# EasyEDA Pro project BlueberryPi.eprj, board PCB1 (continued)
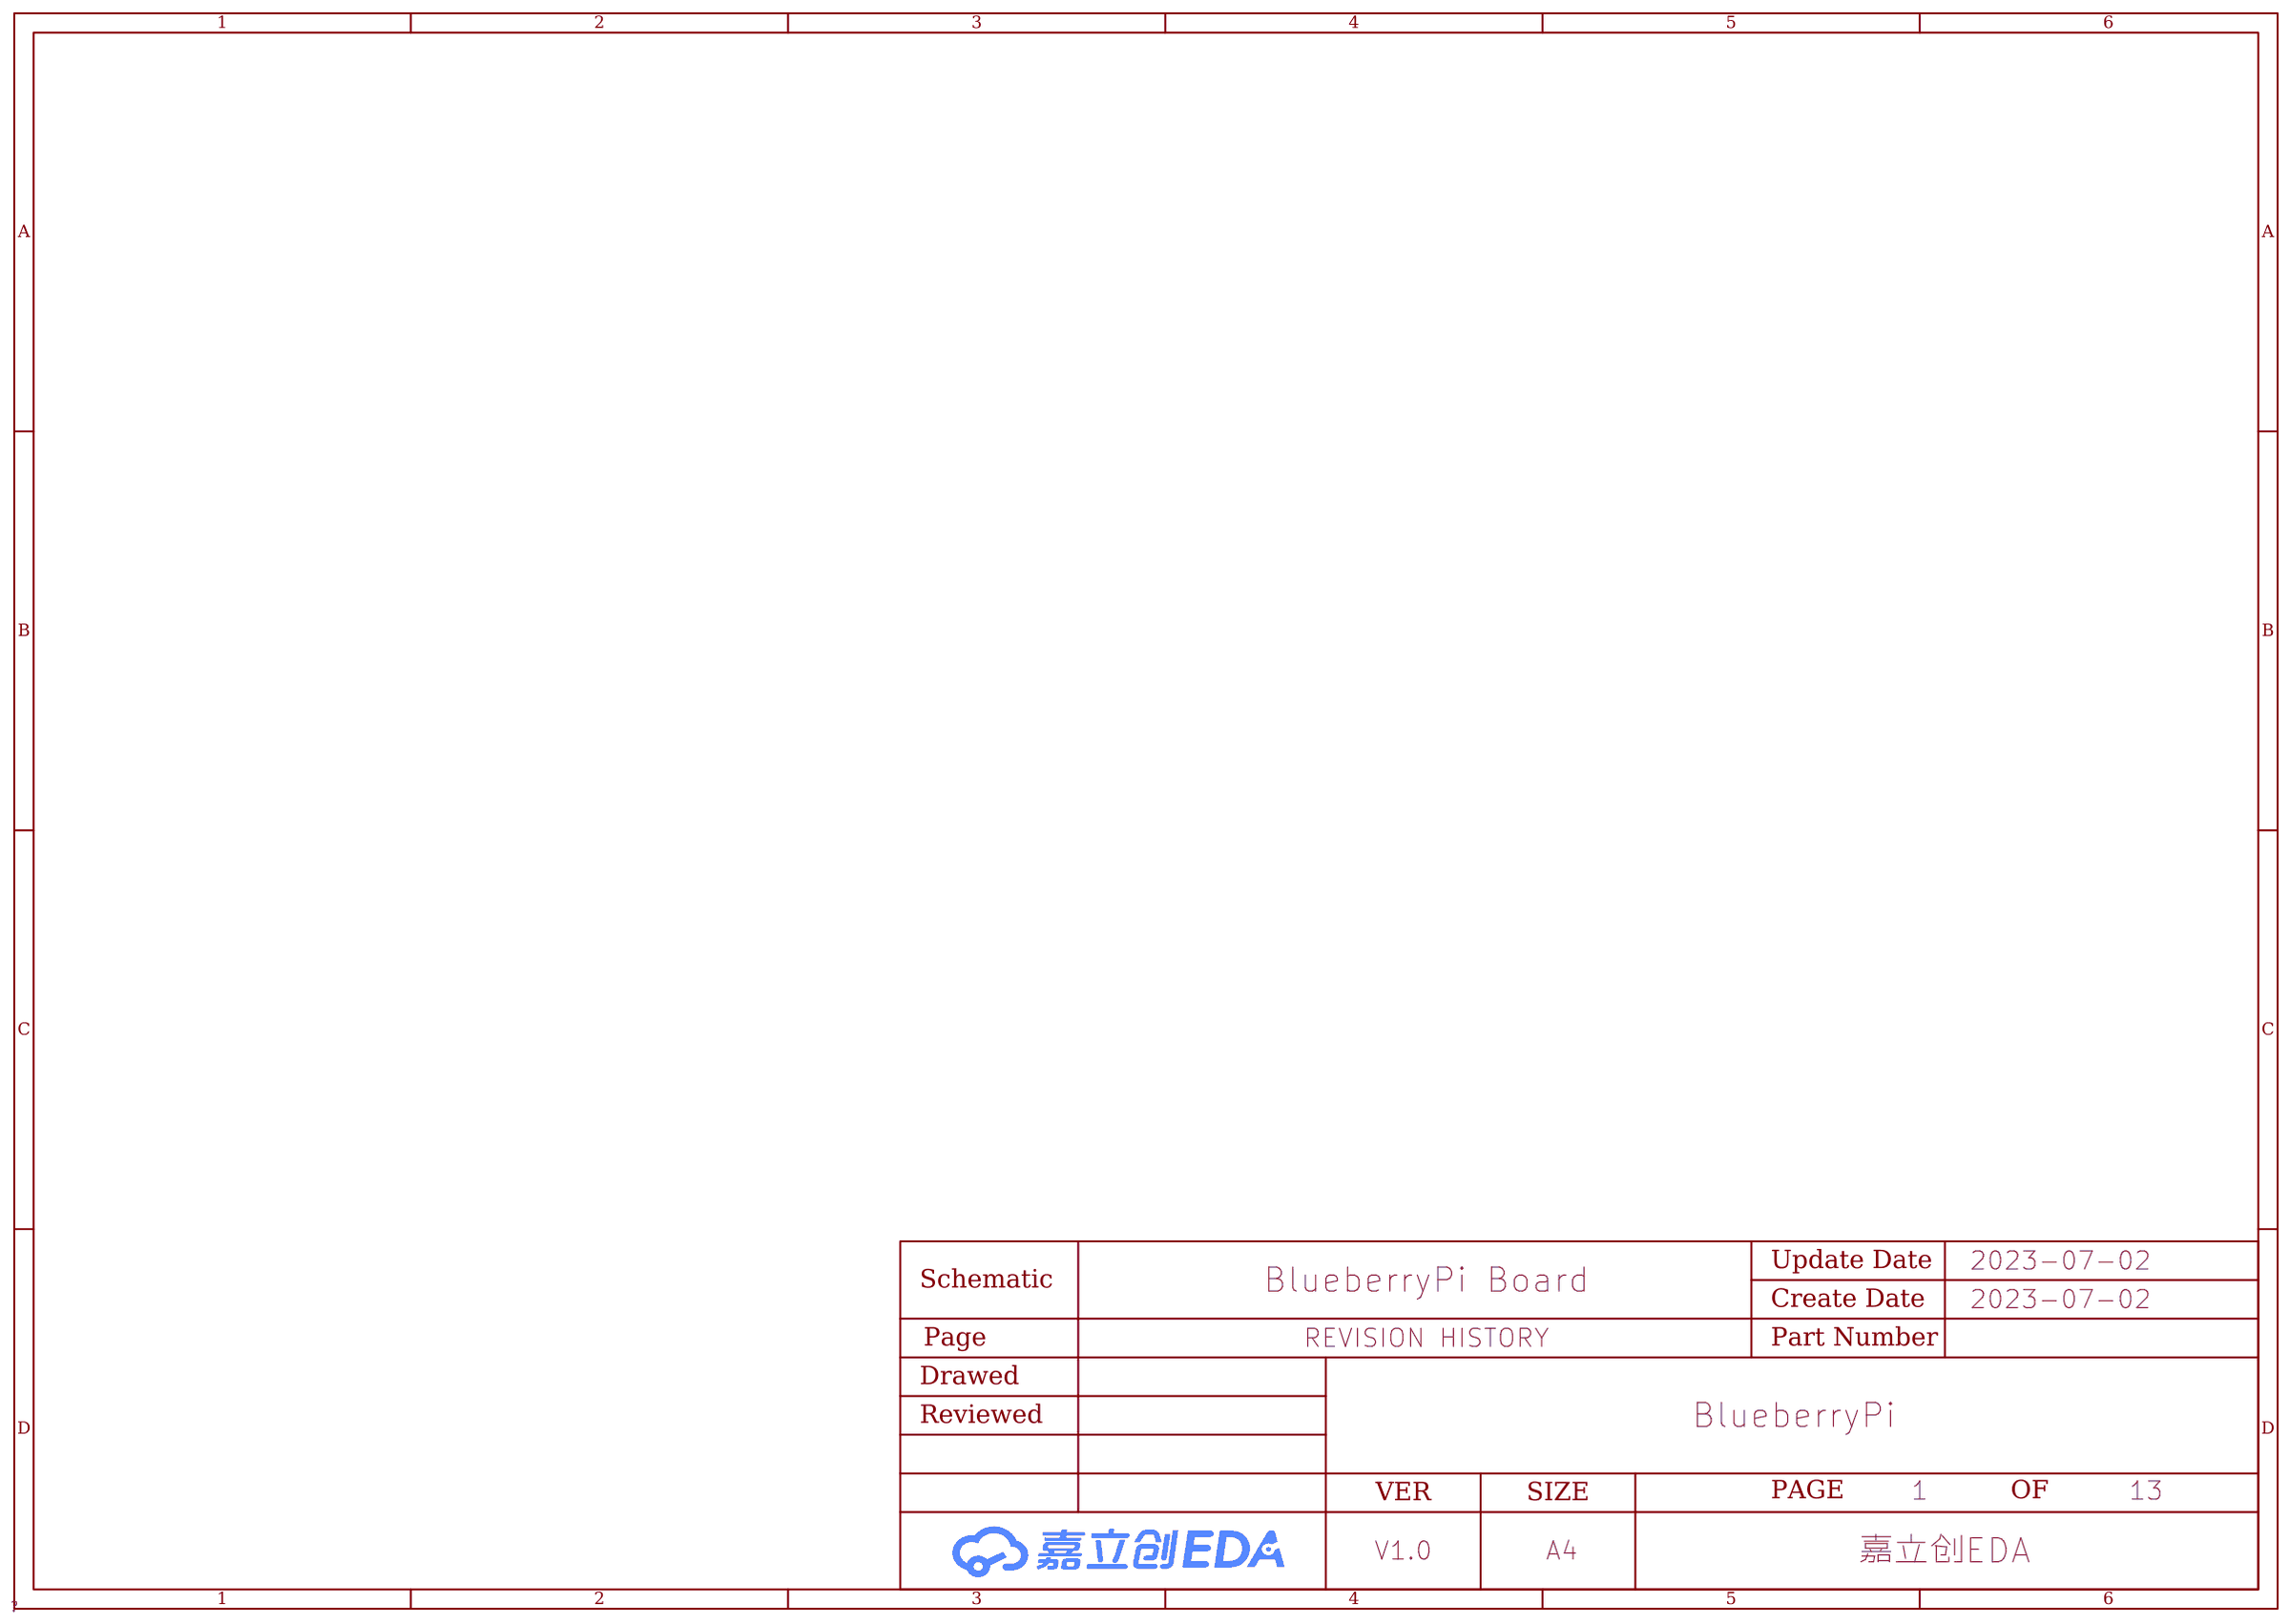
[diagram p0: REVISION HISTORY]
## Routing (per net, layer and track width the routed paths; a pad name or vN(x,y) marks a point on that pad's centre or on a via; arc(x,y) is an arc through that point) (continued)
VCC-PC: length 157.2
  Top Layer w0.203: U39.C6 69.37,49.28 v2(69.37,49.81) ; v2(74.37,48.28) v2(73.87,47.78) v2(74.37,47.28)
  Top Layer w0.254: v2(13.72,41.28) 13.22,40.78 8.63,40.78 R33.1 ; U39.M4 v2(73.87,47.78) ; v2(69.37,50.33) v2(69.37,49.81)
  04PWR w0.254: v2(74.37,48.28) v2(73.87,47.78) ; v2(73.87,47.78) 73.15,47.78 72.89,48.04 72.89,48.53 72.63,48.78 71.78,48.78 71.44,49.12 71.44,49.49 71.12,49.81 v2(69.37,49.81) v2(69.37,50.33) 68.9,50.8 67.03,50.8 65.11,48.88 v2(54.08,48.88) ; v2(73.87,47.78) v2(74.37,47.28)
  Bottom Layer w0.254: v2(28.29,54.99) 27.55,55.73 26.48,55.73 25.73,54.98 25.73,53.29 v2(13.72,41.28) 15.65,39.34 15.65,39.29 17.49,37.45 21.2,37.45 24.37,34.28 24.37,22.8 29.71,17.46 55.05,17.46 74.59,37 R42.1 74.59,47.06 v2(74.37,47.28) 74.37,47.78 ; C1.2 56.13,48.88 v2(54.08,48.88) ; v2(69.37,49.81) v2(69.37,50.33) ; v2(74.37,48.28) 74.37,47.78 ; 74.37,47.78 74.37,47.78 v2(73.87,47.78)
VDD18-LPDDR: length 75.8
  Top Layer w0.254: U35.A3 U35.A4 U35.A5 U35.A6 v2(40.69,27.14) ; v2(58.2,27.14) U35.U6 U35.U5 U35.U4 U35.U3 ; U35.U10 54.74,30.35 v2(54.74,30.45) ; v2(44.07,30.45) 44.22,30.45 U35.A10
  Top Layer w0.305: R26.2 31.99,48.11 v2(31.99,37.53) v2(31.99,36.97)
  03SIG w0.254: v2(31.99,36.97) v2(31.99,37.53) ; 40.69,27.71 40.69,31.21 36.8,35.09 33.54,35.09 31.99,36.64 ; 40.69,27.71 43.43,30.45 v2(44.07,30.45) ; 40.69,27.71 v2(40.69,27.14) 45.59,22.24 53.31,22.24 v2(58.2,27.14) 58.2,27.56 55.31,30.45 v2(54.74,30.45)
  03SIG w0.305: 31.99,36.64 v2(31.99,36.97)
VDD-CPU: length 14.2
  Top Layer w0.203: L2.2 9.35,66.41 C112.2
  Top Layer w0.254: L1.2 3.49,62.86 C110.2
  Top Layer w0.305: v2(52.13,48.23) v2(52.78,48.23) v2(52.78,48.88) ; v2(52.13,48.23) U1.P15 ; v2(52.13,48.23) v2(52.13,48.88) ; v2(52.78,49.53) v2(52.13,49.53) ; v2(52.78,49.53) v2(52.78,48.88) ; v2(52.78,49.53) v2(52.78,50.18) v2(52.13,50.18) v2(52.13,49.53) ; v2(52.13,49.53) v2(52.13,48.88) ; v2(52.78,48.88) v2(52.13,48.88)
  vias: v2(5.77,66.06) v2(5.77,65.3) v2(5.77,64.53) v2(6.53,66.06) v2(6.53,65.3) v2(6.53,64.53) v2(7.29,66.06) v2(7.29,65.3) v2(7.29,64.53) v2(34.04,59.16) v2(35.56,59.16)
VDD-CPUFB: length 109.1
  Top Layer w0.305: v2(52.78,46.93) U1.R16
  04PWR w0.254: v2(29.48,66.66) 30.38,66.66 35.58,61.47 42.22,61.47 42.58,61.82 70.5,61.82 75.93,56.39 75.93,47.04 72.34,43.45 67.06,43.45 63.14,47.36 53.21,47.36 v2(52.78,46.93)
  Bottom Layer w0.254: v2(29.48,66.66) 15.8,66.66 12.88,63.74 v2(12.88,60.66) v2(12.88,60.16)
VDD-CPUS: length 10.3
  04PWR w0.254: v2(59.7,53.8) 59.64,53.86 54.51,53.86 v2(54.08,53.43)
  Bottom Layer w0.254: C10.2 58.86,53.9 C12.2 ; v2(54.08,53.43) 53.77,53.12 53.77,52.53 54.2,52.1 54.2,51.6 v2(53.43,50.83)
VDD-GPU: length 8.3
  Top Layer w0.203: 5.79,53.24 2.78,53.24 2.69,53.33
  Top Layer w0.305: v2(46.93,50.18) v2(46.93,49.53) ; v2(46.93,49.53) v2(47.58,49.53) v2(47.58,48.88) ; v2(46.93,49.53) v2(46.93,48.88) ; v2(46.93,48.88) v2(46.93,48.23) v2(47.58,48.23) v2(47.58,48.88) ; v2(46.93,48.88) v2(47.58,48.88)
  vias: v2(5.26,53.47) v2(5.26,52.7) v2(6.02,53.47) v2(6.02,52.7) v2(6.78,53.47) v2(6.78,52.7) v2(32.91,50.57) v2(34.39,50.27)
VDD-GPUFB: length 66.2
  Top Layer w0.203: U37.47 v2(9.63,58)
  03SIG w0.254: v2(9.63,58) 8.7,57.07 8.7,51.7 4.01,47.02 4.01,43.31 7.61,39.71 v2(28.41,39.71)
  Bottom Layer w0.254: v2(28.41,39.71) 35.33,39.71 44.03,48.41 45.45,48.41 v2(46.28,47.58)
VDD-SYS: length 21.9
  Top Layer w0.203: U37.9 15.08,52.51 15.9,51.69 L4.2 15.9,46.9 C116.2
  Top Layer w0.305: v2(50.83,52.13) v2(50.18,52.13) ; v2(50.83,52.13) v2(50.83,51.48) v2(50.18,51.48) v2(50.18,52.13) ; v2(50.83,52.13) v2(50.83,52.78) v2(50.18,52.78) ; v2(50.18,52.13) v2(50.18,52.78) ; v2(49.53,52.78) v2(50.18,52.78)
  Bottom Layer w0.254: C21.2 50.02,51.48 v2(50.18,51.48) ; C50.2 53.43,55.52 U1.D18 53.07,54.73 52.73,54.39 52.73,53.38 U1.G16 ; v2(49.53,52.78) 49.19,53.12 v2(49.19,53.76) 49.19,54.03 C48.2
  Bottom Layer w0.305: U1.G16 v2(50.83,52.78) v2(50.18,52.78)
  vias: v2(15.65,49.91) v2(15.65,49.15) v2(15.65,48.39) v2(16.41,49.91) v2(16.41,49.15) v2(16.41,48.39) v2(34.39,53.49) v2(35.88,53.34) v2(52.2,52.78) v2(53.47,54.73)
VDDI-EMMC: length 4
  Bottom Layer w0.254: 68.87,46.35 C119.2 C120.2 68.87,45.31 68.87,46.35 ; 68.87,46.35 v2(68.87,46.78)
(no net):
  vias: v1(5.08,93.98) v1(5.08,5.08) v1(93.98,93.98) v1(93.98,5.08)
$AUDIO1_2: length 13.5
  Top Layer w0.127: R64.2 87.66,86.48 89.76,88.59 84.61,88.59 AUDIO1.2
$AUDIO1_3: length 12.1
  Top Layer w0.127: 89.76,94.39 89.76,92.66 91.85,90.58 91.85,84.41 R63.2
$C5_2: length 7.2
  Top Layer w0.127: C5.2 50.46,61.17 50.46,61.05 arc(50.43,60.97) 50.34,60.93 arc(50.25,60.89) 50.22,60.81 50.22,60.75 arc(50.25,60.66) 50.34,60.62 arc(50.43,60.59) 50.46,60.5 50.46,60.44 arc(50.43,60.36) 50.34,60.32 arc(50.25,60.28) 50.22,60.2 50.22,60.14 arc(50.25,60.05) 50.34,60.02 arc(50.43,59.98) 50.46,59.89 50.46,59.83 arc(50.43,59.75) 50.34,59.71 arc(50.25,59.67) 50.22,59.59 50.22,59.53 arc(50.25,59.44) 50.34,59.41 arc(50.43,59.37) 50.46,59.28 50.46,59.17 51.5,58.14 51.5,56.05 U1.B15
$C6_2: length 7.1
  Top Layer w0.127: C6.2 50.72,61.17 50.72,59.28 51.75,58.24 51.75,56.4 51.8,56.35 51.8,55.7 U1.C15
$C40_1: length 3.6
  Top Layer w0.127: R16.2 C40.1 X1.3
$C125_2: length 15.3
  Top Layer w0.305: CARD1.4 v2(16.62,84.7)
  Bottom Layer w0.305: v3(16.62,80.46) 21.85,80.46 v3(22.12,80.19) ; v3(16.62,80.46) v2(16.62,84.7) ; v3(16.62,80.46) 16.57,80.51 v3(14.73,80.51) 13.4,80.51 v3(13.08,80.19)
$C136_2: length 1.9
  Top Layer w0.127: R63.1 C136.2
$C137_2: length 1.9
  Top Layer w0.127: R64.1 C137.2
$C141_2: length 8.9
  Top Layer w0.305: U64.23 19.71,34.92 C141.2 21.21,36.64 L6.1
$C142_1: length 1.6
  Top Layer w0.508: C142.1 JP1.1
$C142_2: length 6.5
  Top Layer w0.508: U64.2 10.16,20.89 arc(9.1,18.33) C142.2
$C147_1: length 2.5
  Top Layer w0.305: C147.1 22.32,5.49 U65.1
$C148_1: length 4.5
  Top Layer w0.305: R92.1 19.91,9.43 20.77,10.3 ; 20.77,10.3 20.94,10.46 U65.5 ; 20.77,10.3 R91.1 20.91,10.61 C148.1
$C152_2: length 4.4
  Top Layer w0.305: U66.5 16.35,3.82 R93.1
$CN1_19: length 5.2
  Top Layer w0.127: R65.2 77.69,87.42 U60.2 76.38,87.5 75.62,88.27 75.26,88.27 74.5,89.02 CN1.19
$D5_1: length 2.5
  Top Layer w0.127: R73.2 71.93,82.42 D5.1
$H1_1: length 2.6
  Top Layer w0.305: H1.1 97.74,39.52 R55.2
$H1_2: length 2.3
  Top Layer w0.305: Q1.3 H1.2
$L1_1: length 10.2
  Top Layer w0.203: U37.43 6.09,59.6 ; 6.09,59.6 6.49,59.2 U37.44 ; 6.09,59.6 L1.1
$L2_1: length 5.7
  Top Layer w0.203: L2.1 12.55,63.19 14.28,61.45 ; U37.36 14.28,61.45 ; 14.28,61.45 14.68,61.05 U37.35
$L3_1: length 10.7
  Top Layer w0.203: U37.50 6.15,56.8 5.79,56.44 5.83,56.4 U37.51
$L4_1: length 5.1
  Top Layer w0.203: 12.7,51.21 14.28,52.79 U37.7
  Top Layer w0.381: 12.7,51.21 L4.1
$L5_1: length 8
  Top Layer w0.203: L5.1 21.06,51 20.77,51.29 20.07,51.29 19.04,52.32 16.97,52.32 16.28,53.01 U37.12
$L6_2: length 6.4
  Top Layer w0.305: U64.21 25.04,31.19 L6.2
$L7_2: length 5.1
  Top Layer w0.305: U65.3 26.46,10.12 L7.2
$LED1_2: length 2.1
  Top Layer w0.254: R57.2 76.53,57.15 LED1.2
$LED2_2: length 2.2
  Top Layer w0.127: R58.2 76.56,60.96 LED2.2
$Q2_1: length 7.7
  Top Layer w0.127: Q2.1 79.77,77.12 79.15,77.75 76.73,77.75 76.09,77.1 Q3.1 76.1,76.89 R69.2 R68.2
$R1_2: length 21.5
  Top Layer w0.127: v2(67.18,50.11) 66.45,49.38 58.65,49.38 57.91,50.11 56.39,50.11 56.1,49.82 55.09,49.82 54.73,49.46 U1.N20
  Bottom Layer w0.127: v2(67.18,50.11) 69.1,52.03 71.97,52.03 R1.2
$R2_2: length 24.4
  Top Layer w0.127: U1.R19 54.42,47.92 v2(55.7,47.92)
  Bottom Layer w0.127: R2.2 72.39,45.59 72.39,44.39 70.38,42.38 66.97,42.38 65.04,44.31 65.04,47 64.12,47.92 v2(55.7,47.92)
$R3_1: length 1.2
  Bottom Layer w0.127: 75.36,52.89 75.35,52.88 R3.1
$R3_2: length 21.5
  Bottom Layer w0.127: v2(54.08,48.23) 54.47,47.84 55,47.84 55.44,48.28 64.54,48.28 69.14,52.88 R3.2
$R4_1: length 1.2
  Bottom Layer w0.127: R4.1 75.37,52.01 R5.2
$R7_1: length 36.4
  Top Layer w0.127: v2(40.98,50.88) 41.46,51.35 42.9,51.35 U1.J2
  03SIG w0.127: v2(22.57,27.76) 26.01,27.76 30.05,31.8 30.05,42.27 38.06,50.28 40.39,50.28 v2(40.98,50.88)
$R8_2: length 8.3
  Top Layer w0.127: U1.B4 44.33,59.31 43.96,59.68 41.01,59.68 40.64,60.05 R8.2
$R9_1: length 8
  Top Layer w0.127: v2(46.35,54.71) 46.35,54.66 U1.E8
  Bottom Layer w0.127: v2(44.45,61.03) 45.67,59.82 45.67,55.4 v2(46.35,54.71)
$R10_1: length 9.4
  Top Layer w0.127: U1.C7 45.57,55.38 45.23,55.72 44.81,55.72 44.65,55.87 44.65,59.5 44.17,59.98 42.06,59.98 41.91,60.13 R10.1
$R11_1: length 8.2
  Top Layer w0.127: U1.E7 45.81,54.55 v2(45.81,54.71)
  Bottom Layer w0.127: v2(45.81,54.71) 45.36,55.16 45.36,58.85 v2(43.18,61.03)
$R18_2: length 4.3
  Top Layer w0.127: U1.W2 42.73,44.68 40.75,44.68 39.59,43.51 39.59,43.26
$R19_1: length 2.6
  Top Layer w0.127: R19.1 43.12,24.35 44.59,24.35 U35.B3
$R37_2: length 9.8
  Top Layer w0.203: 18.44,58.8 U37.26
  Top Layer w0.381: R37.2 24.66,60.1 23.57,59 18.64,59 18.44,58.8
$R41_2: length 9.4
  Top Layer w0.127: R41.2 26.78,58.59 19.02,58.59 18.84,58.4 U37.25
$R49_2: length 1.6
  Top Layer w0.508: U50.4 28.47,80.65 28.98,80.14
$R50_1: length 1.3
  Top Layer w0.508: U50.3 R50.1
$R51_2: length 1.7
  Top Layer w0.508: R51.2 56.71,76.18 U53.4
$R52_1: length 1.8
  Top Layer w0.508: R52.1 55.42,79.55 55.8,79.93 56.37,79.93 56.71,79.59 56.71,79.49
$R53_2: length 1.7
  Top Layer w0.508: R53.2 40.81,76.18 U54.4
$R54_1: length 1.9
  Top Layer w0.508: 40.81,79.49 40.81,79.64 40.44,80.01 40,80.01 R54.1
$R59_1: length 2.3
  Top Layer w0.305: SW1.2 81.78,29.01
$R60_1: length 2.3
  Top Layer w0.305: SW2.2 81.78,20.12
$R61_1: length 2.5
  Top Layer w0.305: SW3.2 71.62,20.24
$R76_1: length 2
  Top Layer w0.127: R76.1 17.37,34.17 U64.24
$R87_1: length 2.2
  Top Layer w0.203: 7.88,32.08 5.67,32.08
$R94_1: length 36.7
  Top Layer w0.127: U1.F2 42.72,53.12 41.53,53.12 40.27,54.38 40.27,55.07 38.29,57.05 38.29,60.35 19.64,79 R94.1
AC-AVCC: length 3.2
  Bottom Layer w0.127: v2(43.68,54.69) 43.31,55.06 C35.2 43.15,56.08 C37.2
AC-LDOIN: length 58.5
  Top Layer w0.203: U37.31 16.28,62.72 v2(16.36,62.8)
  Top Layer w0.254: 42.47,57.99 42.47,57.39 43.68,56.18 U1.B3 U1.C3
  Top Layer w0.305: 39.99,62.48 39.99,62.53 40,62.55 41.26,62.55 41.91,61.9 44.45,61.9 ; 39.99,62.48 v2(39.31,63.17) ; 39.99,62.48 39.99,59.25 41.25,57.99 42.46,57.99
  Bottom Layer w0.305: v2(16.36,62.8) 19.24,65.68 36.79,65.68 v2(39.31,63.17) 39.76,62.71 C45.2 40.44,52.78 41.29,53.63 44.03,53.63 44.33,53.93 v2(44.33,54.08)
AC-VDD-IN: length 4.3
  Top Layer w0.254: v2(45.63,54.08) U1.D5
  Bottom Layer w0.127: v2(45.63,54.08) 45.9,54.35 46.51,54.35 46.72,54.56 46.72,55.2 46.32,55.6 C38.2
ALDO1: length 138.7
  Top Layer w0.203: v2(21.04,60.07) 19.74,60.07 19.26,59.6 U37.28
  Top Layer w0.254: v2(68.78,58.26) 70.63,60.11 80.38,60.11 81.15,59.33 81.15,39.37 v2(70.76,28.98) ; U1.H18 53.74,51.82
  Top Layer w0.305: v2(23.99,61.72) 26.75,61.72
  03SIG w0.254: v2(33.21,62.41) v2(33.78,62.41) 64.63,62.41 v2(68.78,58.26)
  04PWR w0.254: v2(68.78,58.26) 71.18,55.85 71.18,54.11 69.21,52.13 66.07,52.13 65.22,51.28 54.28,51.28 v2(53.75,51.82) ; v2(27.97,56.46) v2(27.97,57.71) 26.87,58.8 22.29,58.8 21.04,60.05 v2(21.04,60.07)
  Bottom Layer w0.254: v2(21.04,60.07) 22.69,61.72 v2(23.99,61.72) 24.68,62.41 v2(33.21,62.41) ; C3.2 53.62,51.94 v2(53.75,51.82)
ALDO3: length 364.7
  Top Layer w0.203: U39.E6 70.18,48.47 ; 70.18,48.47 70.18,48.48 v2(71.01,49.3) ; 70.18,48.47 U39.F5 ; U37.32 15.88,61.5 v2(14.55,62.83) ; v2(71.87,50.78) v2(72.37,50.28) ; U37.19 19.92,56
  Top Layer w0.254: 19.92,56 v2(21.04,57.12)
  Top Layer w0.305: v2(14.73,79) 13.77,78.04 13.77,63.61 v2(14.55,62.83) ; v2(39.37,10.91) v2(36.83,10.91) 32.91,6.99 32.91,4.47 33.57,3.81 U7.1 35.6,2.5 53.29,2.5 54.6,3.81 U7.17 ; R56.2 92.21,37.96 v2(92.97,37.96) ; v2(21.04,57.12) 21.91,56.26 24.08,56.26 25.35,54.99 v2(26.78,54.99)
  Top Layer w0.508: v3(72.82,76.5) 72.82,75.72 ; v3(72.82,77.21) 72.82,78.48 72.17,79.13 Q4.1 v2(71.94,80.35) D5.2 ; v3(77.98,74.55) R66.2
  03SIG w0.254: v2(45.63,47.58) 46.38,48.33 46.38,51.59 46.93,52.13 46.93,52.78 v2(46.93,52.78) ; v2(39.76,51.56) 41.55,53.35 45.52,53.35 46.28,54.11 46.67,54.11 47.52,54.97 49.94,54.97 v2(50.83,54.08)
  03SIG w0.305: v2(75.37,49.94) 75.03,50.28 v2(72.37,50.28) 71.99,50.28 71.87,50.16 ; 71.87,50.16 v2(71.87,50.78) ; 71.87,50.16 v2(71.01,49.3) 69.98,48.27 69.98,46.41 69.05,45.48 67.45,45.48 65.19,43.22 52.93,43.22 52.12,42.41 44.32,42.41 43.23,43.5 43.23,45.17 45.63,47.57 v2(45.63,47.58)
  Bottom Layer w0.203: v2(72.37,50.28) 72.56,50.28 72.9,49.94 75.36,49.94 R5.1
  Bottom Layer w0.254: 30.51,54.99 29.72,54.2 27.57,54.2 v2(26.78,54.99) ; C122.2 72.09,50.48 71.55,49.95 71.55,49.85 v2(71.01,49.3) ; v2(71.87,50.78) v2(72.37,50.28)
  Bottom Layer w0.305: v2(46.93,52.78) 46.7,53.01 41.65,53.01 40.19,51.56 v2(39.76,51.56) 39.15,52.17 37.99,52.17 35.17,54.99 30.51,54.99 ; v3(77.98,74.55) 80.33,76.9 91,76.9 92.97,74.92 v2(92.97,37.96) 92.97,11.26 83.74,2.03 56.39,2.03 U7.17 ; v2(14.55,62.83) 15.35,62.03 17.51,62.03 18,61.54 18,58.55 18.45,58.09 20.08,58.09 v2(21.04,57.12) ; v2(14.73,79) 54.64,79 55.99,80.35 v2(71.94,80.35)
  Bottom Layer w0.508: v3(72.82,77.21) v3(72.82,76.5) 72.82,75.73 v3(72.82,75.72) 73.98,74.55 v3(76.1,74.55) v3(77.06,74.55) v3(77.98,74.55)
AP-CK32KO: length 59.7
  Top Layer w0.127: v2(54.24,52.78) 54.73,52.78
  Top Layer w0.203: R86.1 v2(18.26,35.93)
  03SIG w0.127: v2(18.26,35.93) 27.8,35.93 29.54,37.66 29.54,42.53 42.1,55.09 46.49,55.09 46.96,55.56 50.13,55.56 51.24,54.45 51.24,53.87 50.94,53.57 50.15,53.57 49.57,54.15 49.06,54.15 48.77,53.86 48.77,53.35 48.34,52.92 48.34,52.36 48.56,52.13 48.88,52.13 49.95,51.07 51.02,51.07 51.49,51.54 51.49,52.91 51.87,53.29 53.55,53.29 54.06,52.78 v2(54.24,52.78)
AP-NMI: length 50.6
  Top Layer w0.203: R38.2 19.17,54.8 U37.16
  03SIG w0.127: v2(55.38,52.78) 56.6,52.78 57.72,53.9 57.72,57.01 56.65,58.08 55.34,58.08 54.93,58.49 48.12,58.49 45.78,56.16 40.06,56.16 36.63,52.73 21.23,52.73 v2(19.56,54.4)
  Bottom Layer w0.127: v2(55.38,52.78) 55.63,52.53 C8.1
AP-RESET: length 109.1
  Top Layer w0.127: v2(60.91,53.12) 60.9,53.12 U4.2 58.98,53.12 58.68,53.42 57.49,53.42 56.86,52.78 U1.G22
  Top Layer w0.203: v2(21.22,52.04) 20.14,52.04 18.69,53.49 18.69,53.89 18.18,54.4 U37.15
  Top Layer w0.305: R59.2 C132.2
  03SIG w0.203: v2(82.66,28.98) 82.66,47.74 78.16,52.25 61.78,52.25 v2(60.91,53.12) 60.91,55.88 59.7,57.09 59.7,59.62 59.1,60.22 56.18,60.22 55.71,59.74 45.3,59.74 43.57,58.01 31.48,58.01 29.13,55.66 25.06,55.66 24.31,54.92 19.3,54.92 18.83,54.45 18.83,53.59 20.38,52.04 v2(21.22,52.04)
AP-WAKE-BT: length 113.3
  Top Layer w0.127: v2(68.91,54.01) 68.33,54.01 63.95,49.63 58.72,49.63 57.91,50.43 56.28,50.43 U1.L22
  Top Layer w0.203: U64.6 v2(13.77,19.03)
  03SIG w0.127: v2(13.77,19.03) v2(22.26,19.03)
  Bottom Layer w0.127: v2(68.91,54.01) 76,54.01 76.77,53.24 76.77,38.6 55.26,17.08 24.21,17.08 v2(22.26,19.03)
BIAS-ITEST: length 5.5
  Bottom Layer w0.127: v2(54.73,54.73) 54.86,54.73 55.82,55.69 57.39,55.69 58.62,56.92 R15.1
BIAS-REXT: length 4.5
  Bottom Layer w0.127: R14.1 58.46,55.73 58.17,55.44 55.89,55.44 55.38,54.92 v2(55.38,54.73)
BIAS-VRAL: length 6.6
  Bottom Layer w0.127: C9.1 58.86,58.1 56.71,55.94 55.72,55.94 54.88,55.11 54.46,55.11 v2(54.08,54.73)
BLDO1: length 194.8
  Top Layer w0.127: v2(59.02,43.98) 59.02,44.02 58.37,44.67 56.34,44.67 U1.W22
  Top Layer w0.203: U37.2 12.28,53.14 11.68,52.54
  Top Layer w0.254: 8.89,49.92 7.96,49 7.96,45.85 8.64,45.18 8.64,42.66 9.84,41.45 12.66,41.45 13.5,42.29 14.5,42.29 v2(15.71,41.08)
  Top Layer w0.305: 11.68,52.54 9.06,49.92 8.89,49.92
  04PWR w0.254: v2(53.43,48.23) 53.87,47.79 54.86,47.79 55.46,48.39 63.93,48.39 64.86,47.46 64.86,46.42 66.01,45.26 69.47,45.26 70.6,46.39 72.58,46.39 72.83,46.14 73.95,46.14 74.88,47.07 74.88,56.38 70.81,60.44 v2(67.86,60.44) 67.86,56.3 65.85,54.29 54.44,54.29 54.23,54.08 v2(54.08,54.08)
  Bottom Layer w0.254: C57.2 53.53,48.08 54.75,46.86 56.95,44.67 58.37,44.67 60.4,42.64 60.4,23.44 54.91,17.96 30.62,17.96 24.87,23.71 24.87,34.3 21.2,37.97 18.82,37.97 v2(15.71,41.08) ; C46.2 55.87,54.08 v2(54.08,54.08) ; R12.2 54.56,59.07 56.52,61.04 67.26,61.04 v2(67.86,60.44)
BLDO2: length 77.6
  Top Layer w0.203: 11.61,53.16 11.88,53.43 U37.1
  Top Layer w0.254: U1.H11 v2(48.88,52.78)
  Top Layer w0.305: 11.61,53.16 10.95,53.16 8.64,50.85 7.51,50.85 6.98,50.33 C103.2 5.97,48.88 5.97,44.95 R33.2
  03SIG w0.254: 53.38,55.38 52.74,54.75 52.74,54.09 52.3,53.65 51.53,53.65 51.09,53.21 49.31,53.21 v2(48.88,52.78) ; 53.38,55.38 53.38,55.96 52.16,57.18 49.14,57.18 47.83,55.87 40.54,55.87 37.74,53.07 37.74,51.64 33.52,47.41 10.47,47.41 v2(6.98,43.93) ; 53.38,55.38 54.07,55.38 v2(54.08,55.38)
  Bottom Layer w0.254: 54.47,56.63 53.95,56.63 ; 54.47,56.63 C53.2 ; 54.47,56.63 54.08,56.24 ; 53.95,56.63 54.08,56.5 54.08,56.24 ; 53.95,56.63 C52.2 ; v2(54.08,55.38) 54.08,56.24
BLDO3: length 11.4
  Top Layer w0.203: 12.5,51.91 13.08,52.5 U37.4
  Top Layer w0.305: R35.2 9.88,44.85 9.88,49.01 10.8,49.92 10.8,50.21 12.5,51.91
BT-PCM-CLK: length 36.3
  Top Layer w0.127: U64.26 15.57,36.37 17.4,38.2 19.72,38.2 22.24,40.72 26.11,40.72 v2(27.97,42.57)
  Bottom Layer w0.127: v2(42.99,50.89) 34.67,42.57 v2(27.97,42.57)
BT-PCM-DIN: length 37.5
  Top Layer w0.127: v2(26.02,41.44) 25.86,41.28 22.4,41.28 19.56,38.43 17.08,38.43 14.66,36 U64.27
  Bottom Layer w0.127: v2(43.68,50.27) 35.01,41.59 26.17,41.59 v2(26.02,41.44)
BT-PCM-DOUT: length 36.7
  Top Layer w0.127: U64.25 16.46,36.74 17.69,37.97 19.95,37.97 22.16,40.18 26.31,40.18 v2(27.32,41.19)
  Bottom Layer w0.127: v2(27.32,41.19) 35.25,41.19 v2(44.33,50.27)
BT-PCM-SYNC: length 38.4
  Top Layer w0.127: v2(25.43,42.09) 25.16,41.82 22.57,41.82 19.41,38.66 16.79,38.66 13.77,35.64 U64.28
  Bottom Layer w0.127: v2(43.73,50.9) 34.91,42.09 v2(25.43,42.09)
BT-REG-ON: length 148.5
  Top Layer w0.203: R87.2 v2(4.8,30.86)
  03SIG w0.127: v2(4.8,30.86) 5.52,30.86 11.52,24.87 23.32,24.87 29.69,18.49 v2(29.69,16.28)
  Bottom Layer w0.127: v2(54.08,50.18) 54.65,49.62 55.67,49.62 55.8,49.74 63.86,49.74 69.6,55.49 76.91,55.49 78.14,54.25 78.14,17.45 74.41,13.72 32.26,13.72 v2(29.69,16.28)
BT-UART-CTS: length 65.7
  Top Layer w0.127: v2(23.79,44.12) 23.38,44.12 18.83,39.57 5.79,39.57 3.17,36.96 3.17,23.9 4.32,22.76 5.03,22.76 v2(5.67,22.12)
  Top Layer w0.203: 7.88,23.09 6.63,23.09 v2(5.67,22.12)
  Bottom Layer w0.127: v2(43.68,52.17) 42.79,52.17 34.74,44.12 v2(23.79,44.12)
BT-UART-RTS: length 58.5
  Top Layer w0.127: v2(24.69,43.05) 23.99,42.35 22.71,42.35 19.24,38.89 6.17,38.89 4,36.72 4,26.73 4.33,26.4 5.04,26.4 v2(5.67,25.78)
  Top Layer w0.203: 7.88,25.78 v2(5.67,25.78)
  Bottom Layer w0.127: v2(24.69,43.05) 34.54,43.05 v2(42.38,50.89)
BT-UART-RX: length 64.7
  Top Layer w0.127: v2(23.79,43.54) 23.18,43.54 18.99,39.34 5.92,39.34 3.45,36.88 3.45,24.57 4.05,23.98 5.06,23.98 v2(5.67,23.37)
  Top Layer w0.203: v2(5.67,23.37) 6.28,23.98 7.88,23.98
  Bottom Layer w0.127: v2(44.33,52.17) 44.33,52.09 43.9,51.66 42.62,51.66 34.49,43.54 v2(23.79,43.54)
BT-UART-TX: length 65.9
  Top Layer w0.127: v2(5.67,24.59) 5.06,25.2 4.38,25.2 3.72,25.86 3.72,36.8 6.04,39.12 19.13,39.12 22.92,42.91 v2(23.79,42.91) ; U1.J6 45.63,50.84
  Top Layer w0.203: v2(5.67,24.59) 5.97,24.89 7.88,24.89
  Bottom Layer w0.127: v2(45.63,50.84) 35.55,40.75 25.95,40.75 v2(23.79,42.91)
BT-WAKE-AP: length 136.8
  Top Layer w0.127: U64.7 v2(14.66,22.97)
  03SIG w0.127: v2(28.64,15.23) 20.54,23.33 15.01,23.33 v2(14.66,22.97)
  Bottom Layer w0.127: v2(55.38,50.22) 63.68,50.22 69.8,56.34 77.53,56.34 79.07,54.8 79.07,16.98 74.65,12.56 31.31,12.56 v2(28.64,15.23)
CLDO2: length 14
  Top Layer w0.203: U37.17 18.64,55.2 18.71,55.12 20.79,55.12 v2(21.04,55.37) ; v2(18.73,56.92) 18.73,56.77 18.36,56.4 U37.20
  Top Layer w0.305: R36.1 25.1,53.39 24.04,54.46 21.96,54.46 v2(21.04,55.37)
  04PWR w0.305: v2(21.04,55.37) 19.49,56.92 v2(18.73,56.92)
CPUX-URX: length 91.3
  Top Layer w0.127: U1.D12 49.35,54.73 48.56,55.52 48.56,56.76 48.35,56.97 48.08,56.97 47.21,57.85 46.84,57.85 46.11,58.57 v2(46.11,65.62)
  Top Layer w0.305: v2(91.67,36.55) 92.16,36.06 Q1.2
  03SIG w0.127: v2(46.11,65.62) 50.72,70.23 84.67,70.23 91.67,63.23 v2(91.67,36.55)
CPUX-UTX: length 89.7
  Top Layer w0.127: U1.C9 47.34,55.38 47.01,55.72 46.79,55.72 46.61,55.89 46.61,56.77 44.93,58.45 v2(44.93,64.57)
  03SIG w0.127: v2(44.93,64.57) 44.93,66.12 49.87,71.06 85.22,71.06 94.33,61.94 v2(94.33,39.52)
DCXO-LDOOUT:
  vias: v2(56.03,54.73)
DCXO-XIN: length 3.7
  Top Layer w0.127: X1.1 58.61,56.62 C39.1 58.02,56.03 U1.B23
DCXO-XOUT: length 6.7
  Top Layer w0.127: U1.B22 56.39,56.39 56.39,56.96 57.25,57.82 57.25,60.76 R16.1
DDC_CEC_EN: length 48.9
  Top Layer w0.127: v2(48.23,53.47) 48.27,53.47 U1.E11 ; v2(74.52,73.01) R68.1
  Bottom Layer w0.127: v2(74.52,73.01) 73.48,73.01 71.13,75.36 71.13,76.06 70.09,77.1 58.49,77.1 48.09,66.7 48.09,55.88 48.63,55.35 48.63,53.87 v2(48.23,53.47)
EMMC-CLK: length 0.3
  Bottom Layer w0.127: v2(73.37,48.78) 73.37,48.78 73.37,49.12
EMMC-CMD: length 21.7
  Top Layer w0.127: U1.M21 55.7,49.21 56.96,49.21 57.2,48.97 66.54,48.97 66.81,49.25 v2(67.2,49.25)
  Bottom Layer w0.127: R42.2 73.37,45.82 v2(73.37,48.28) 73.03,48.28 72.61,48.7 69.86,48.7 69.32,49.25 v2(67.2,49.25)
EMMC-D0: length 12.5
  Top Layer w0.127: v2(65.77,48.29) 56.8,48.29 56.21,48.88 U1.N22
  Bottom Layer w0.127: v2(65.77,48.29) 66.69,48.29 67.69,47.28 v2(67.87,47.28)
EMMC-D1: length 11.6
  Top Layer w0.127: U1.N23 56.89,48.67 v2(66.95,48.67)
  Bottom Layer w0.127: v2(67.87,47.78) 66.98,48.67 v2(66.95,48.67)
EMMC-D2: length 12.1
  Top Layer w0.127: U1.R22 56.35,47.9 67.24,47.9 67.62,48.28 U39.A5
EMMC-D3: length 12
  Top Layer w0.127: v2(66.74,47.46) 66.62,47.58 U1.R23
  Bottom Layer w0.127: v2(68.37,46.78) 67.42,46.78 v2(66.74,47.46)
EMMC-D4: length 20.5
  Top Layer w0.127: v2(66.74,46.58) 58.27,46.58 57.92,46.93 U1.T22
  Bottom Layer w0.127: v2(68.37,47.28) 69.03,47.28 69.27,47.04 69.27,45.92 69.39,45.8 69.39,43.8 69.15,43.56 67.5,43.56 67.22,43.84 67.22,46.1 v2(66.74,46.58)
EMMC-D5: length 22.5
  Top Layer w0.127: v2(66.05,46.16) 58.01,46.16 57.54,46.63 55.68,46.63 U1.T21
  Bottom Layer w0.127: v2(66.05,46.16) 66.38,46.16 66.73,45.82 66.73,43.8 67.39,43.14 69.22,43.14 69.77,43.7 69.77,46.16 69.61,46.33 69.61,47.33 69.16,47.78 v2(68.37,47.78)
EMMC-D6: length 20.9
  Top Layer w0.127: U1.U19 54.63,46.28 55.08,45.83 55.08,45.52 55.28,45.31 v2(70.17,45.31)
  Bottom Layer w0.127: v2(68.37,48.28) 69.28,48.28 70.17,47.4 v2(70.17,45.31)
EMMC-D7: length 19.9
  Top Layer w0.127: U1.U21 55.74,45.92 56.92,45.92 57.05,45.8 v2(70.61,45.8)
  Bottom Layer w0.127: v2(68.37,48.78) 69.39,48.78 70.61,47.56 v2(70.61,45.8)
EMMC-DS: length 24.6
  Top Layer w0.127: U1.R20 55.05,47.26 58.15,47.26 58.34,47.07 v2(65.58,47.07)
  Bottom Layer w0.127: v2(71.37,48.28) 71.37,44.64 69.48,42.75 67.21,42.75 66.26,43.7 66.26,45.19 65.58,45.86 v2(65.58,47.07)
EMMC-RST: length 1.2
  Bottom Layer w0.127: v2(72.37,48.28) 72.36,48.27 R2.1
HCEC: length 44.9
  Top Layer w0.127: R72.1 71.32,76.35 71.32,76.91 71.64,77.23 v2(71.94,77.23)
  Bottom Layer w0.127: v2(71.94,77.23) 71.94,77.36 71.13,78.17 58.59,78.17 47.28,66.86 47.28,54.33 v2(47.52,54.08)
HDMI-5V: length 11.7
  Top Layer w0.305: CN1.18 74,88.89 75.21,87.68 U59.2 75.64,87.42 75.79,87.27 75.79,86.16 77.42,84.53 78.84,84.53
  Top Layer w0.508: R67.2 R71.2 78.79,84.49 78.84,84.53
HDMI-CEC: length 14.2
  Top Layer w0.127: CN1.13 71.5,88.37 71.7,88.16 U63.2 72.12,87.42 72.28,87.26 72.28,85.29 74.37,83.2 R73.1 75.01,80.21 75.01,78.59 74.6,78.18 Q4.3
HDMI-SCL: length 22.5
  Top Layer w0.127: CN1.15 72.5,88.37 72.87,88 U62.2 73.29,87.42 73.46,87.25 73.46,84.77 75.92,82.31 75.92,79.08 76.63,78.37 80.2,78.37 80.72,78.89 Q2.3 80.72,79.58 79.83,80.47 79.12,80.47 77.93,81.66
HDMI-SDA: length 14.5
  Top Layer w0.127: 76.43,82.6 74.62,84.4 74.62,87.25 74.46,87.42 U61.2 74.04,87.56 73,88.59 CN1.16 ; 76.43,82.6 76.78,82.96 R71.1 ; 76.43,82.6 77.04,81.99 Q3.3
HHPD: length 58.9
  Top Layer w0.127: v2(77.7,86.56) 78.07,86.56 78.92,87.41 81.36,87.41 82.72,86.06 v2(82.72,65.68)
  Bottom Layer w0.127: v2(82.72,65.68) 74.5,65.68 67.81,58.99 58.64,58.99 56.68,57.03 56.68,56.43 56.44,56.19 55.44,56.19 v2(54.73,55.47)
HOST3_DM: length 38.3
  Top Layer w0.102: U1.A12 49.35,56.86 49.35,56.94 arc(49.39,57.02) 49.48,57.06 49.53,57.06 arc(49.66,57.19) 49.53,57.32 49.48,57.32 arc(49.35,57.44) 49.48,57.57 49.53,57.57 arc(49.66,57.7) 49.53,57.82 49.48,57.82 arc(49.39,57.86) 49.35,57.95 49.35,58.15 48.1,59.4 48.1,80.55 46.79,81.86 46.79,82.56 46.82,82.6 v3(47.15,82.6)
  Bottom Layer w0.102: v3(47.15,82.6) 46.86,82.6 46.83,82.64 46.83,85.9 47.62,86.7 47.62,87.13 48.92,88.42 48.92,89.09 49.95,90.12 49.95,90.27 49.99,90.3 USB3.2
HOST3_DP: length 38.4
  Top Layer w0.102: U1.B12 49.53,56.06 49.12,56.47 49.12,58.05 47.87,59.31 47.87,80.46 46.56,81.77 46.56,82.56 46.52,82.6 v3(46.2,82.6)
  Bottom Layer w0.102: v3(46.2,82.6) 46.56,82.6 46.6,82.64 46.6,85.99 47.4,86.79 47.4,87.22 48.69,88.52 48.69,89.19 49.72,90.21 49.72,90.27 49.68,90.3 USB3.3
HSCL: length 55.9
  Top Layer w0.127: Q2.2 81.69,76.88 81.69,75.52
  Bottom Layer w0.127: v2(48.26,54.08) 48.26,55.04 47.81,55.49 47.81,66.75 58.53,77.47 70.42,77.47 71.59,76.3 71.59,75.65 73.76,73.48 80.72,73.48 81.69,74.45 v2(81.69,75.41)
HSDA: length 51.7
  Top Layer w0.127: 77.98,75.46 77.98,76.89 v2(77.99,76.9)
  Bottom Layer w0.127: v2(46.28,53.47) 46.28,53.73 47,54.45 47,66.91 58.63,78.54 76.35,78.54 v2(77.99,76.9)
HTX0N: length 40.8
  Top Layer w0.102: U1.B19 54.14,56.03 54.42,56.31 54.42,62.26 69.12,76.96 69.12,86.07 69.25,86.2 D3.2 D3.9 69.25,87.94 69.12,88.07 69.12,88.5 69.5,88.89 CN1.9